# EasyEDA Pro project 一堆模块~.eprj (continued)
## Notes on the sheet (continued)
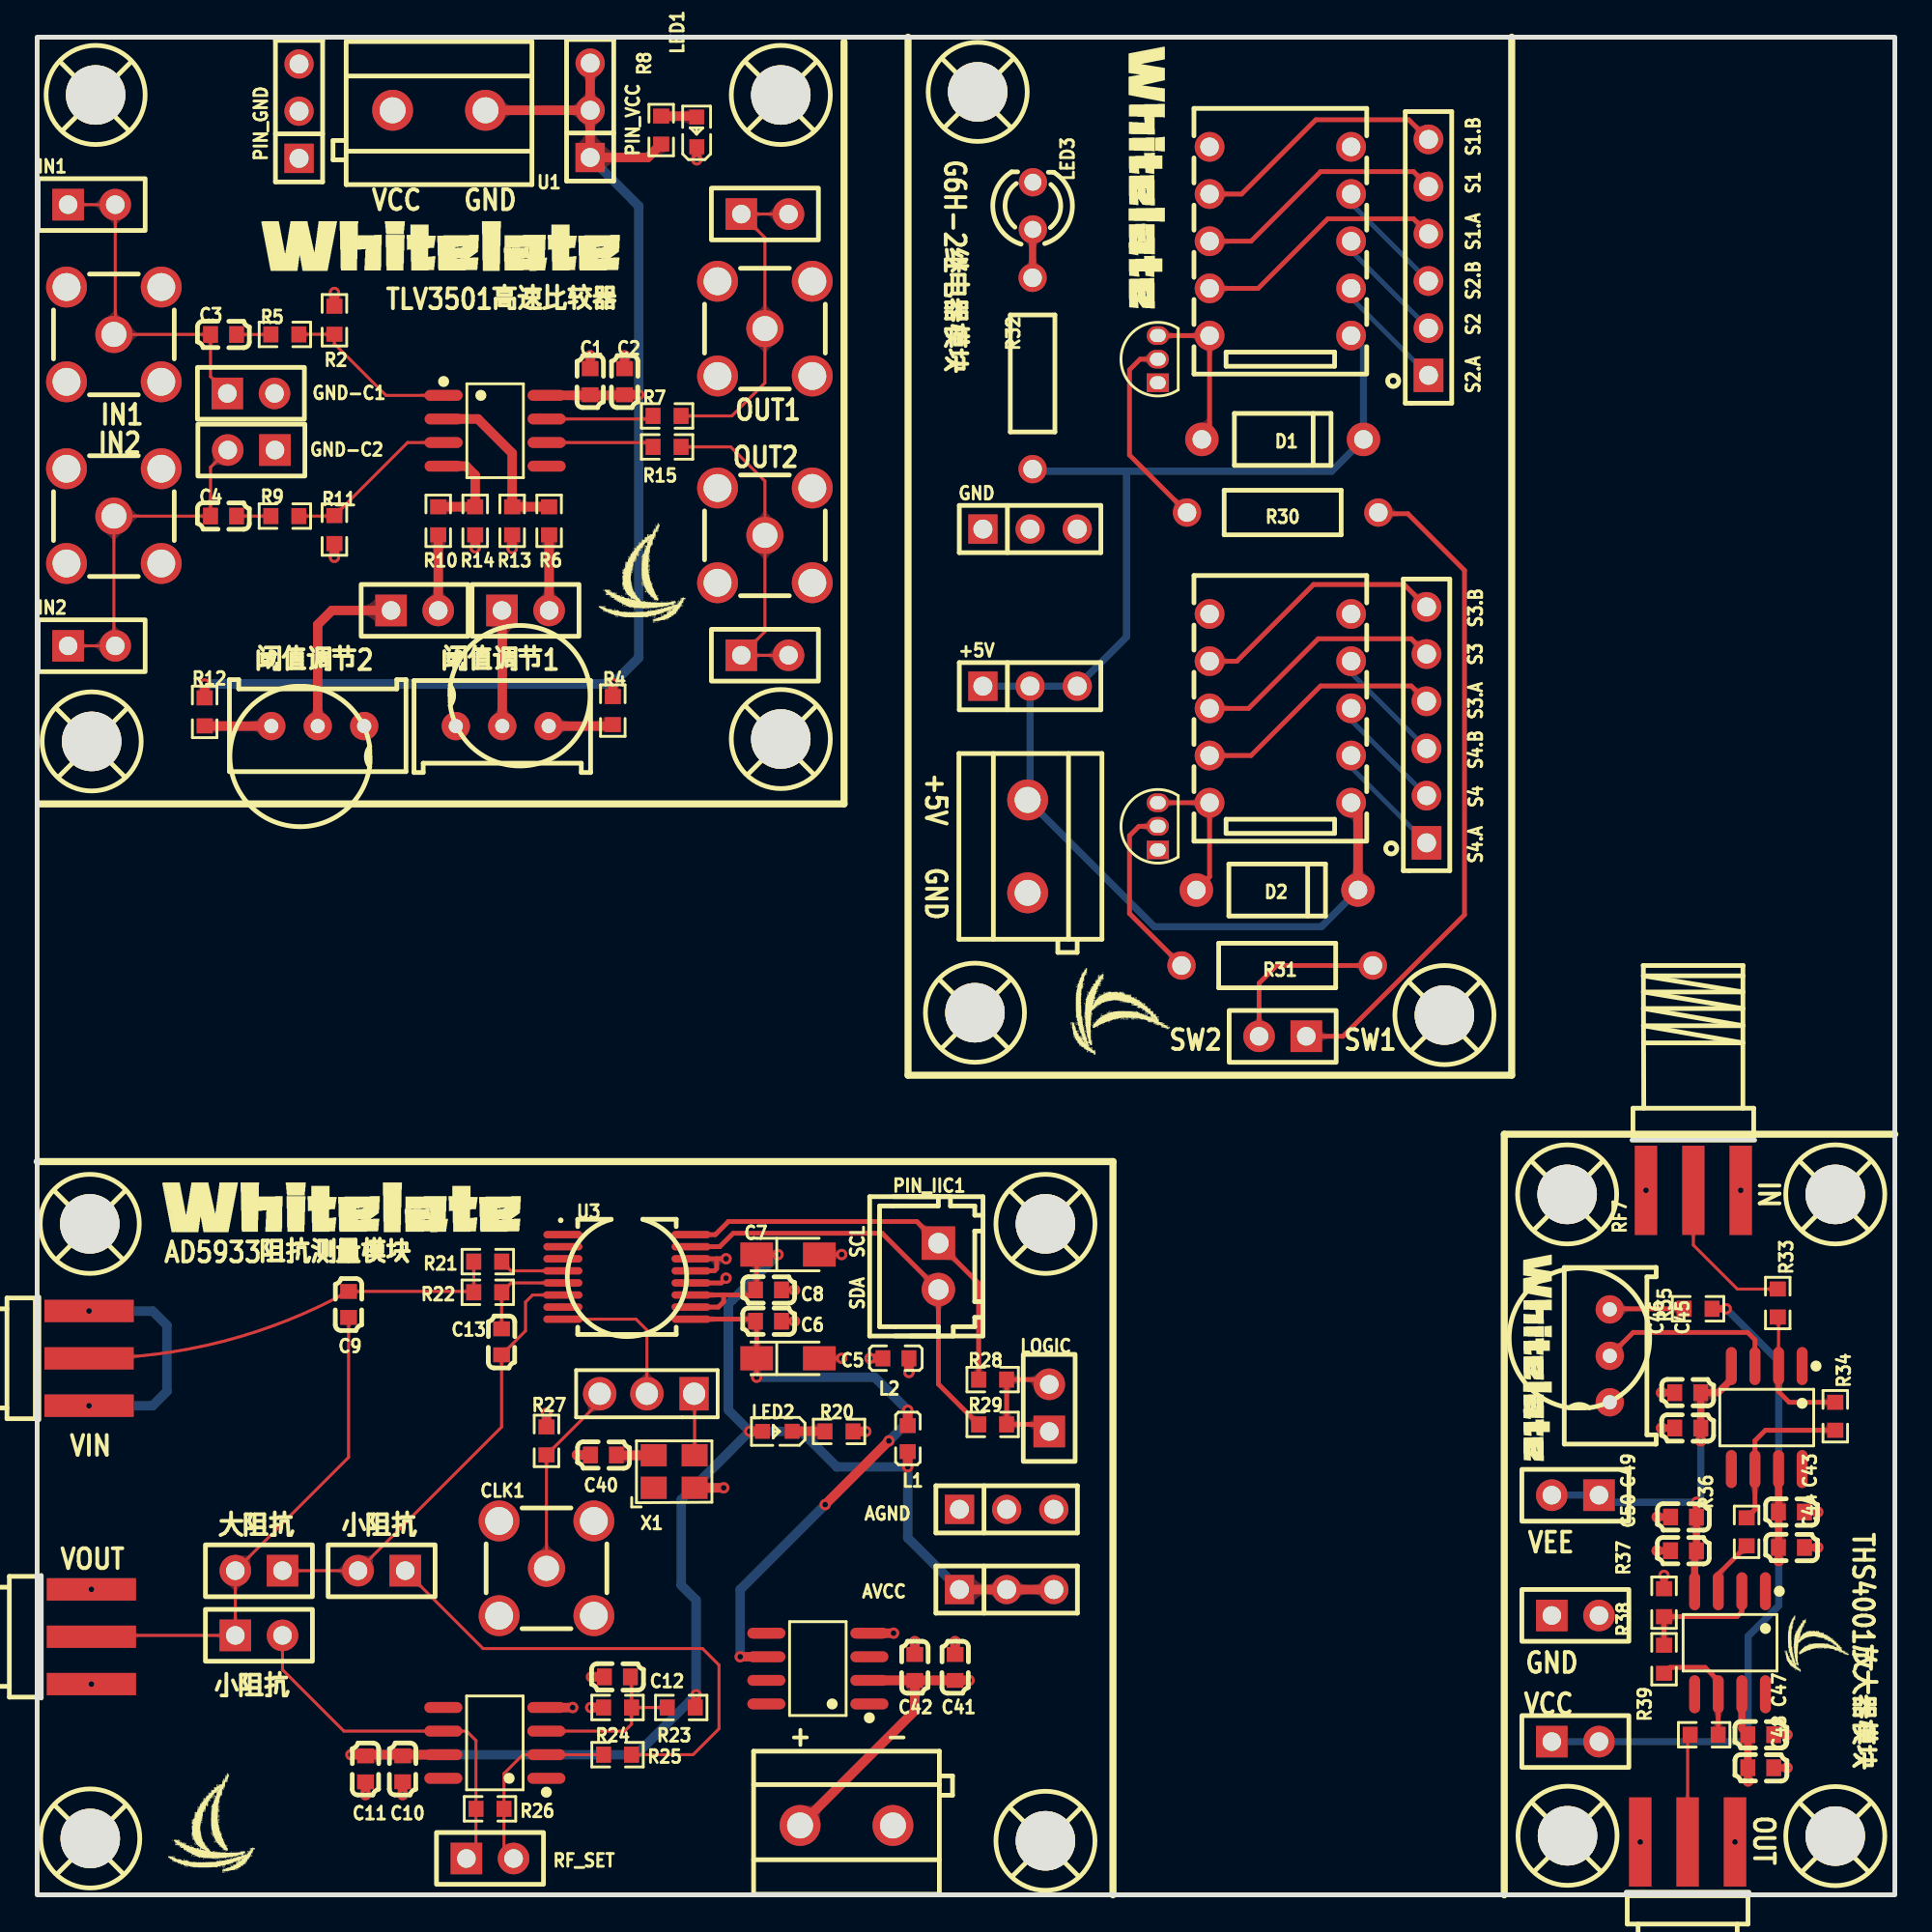
[diagram p1: board, top side]
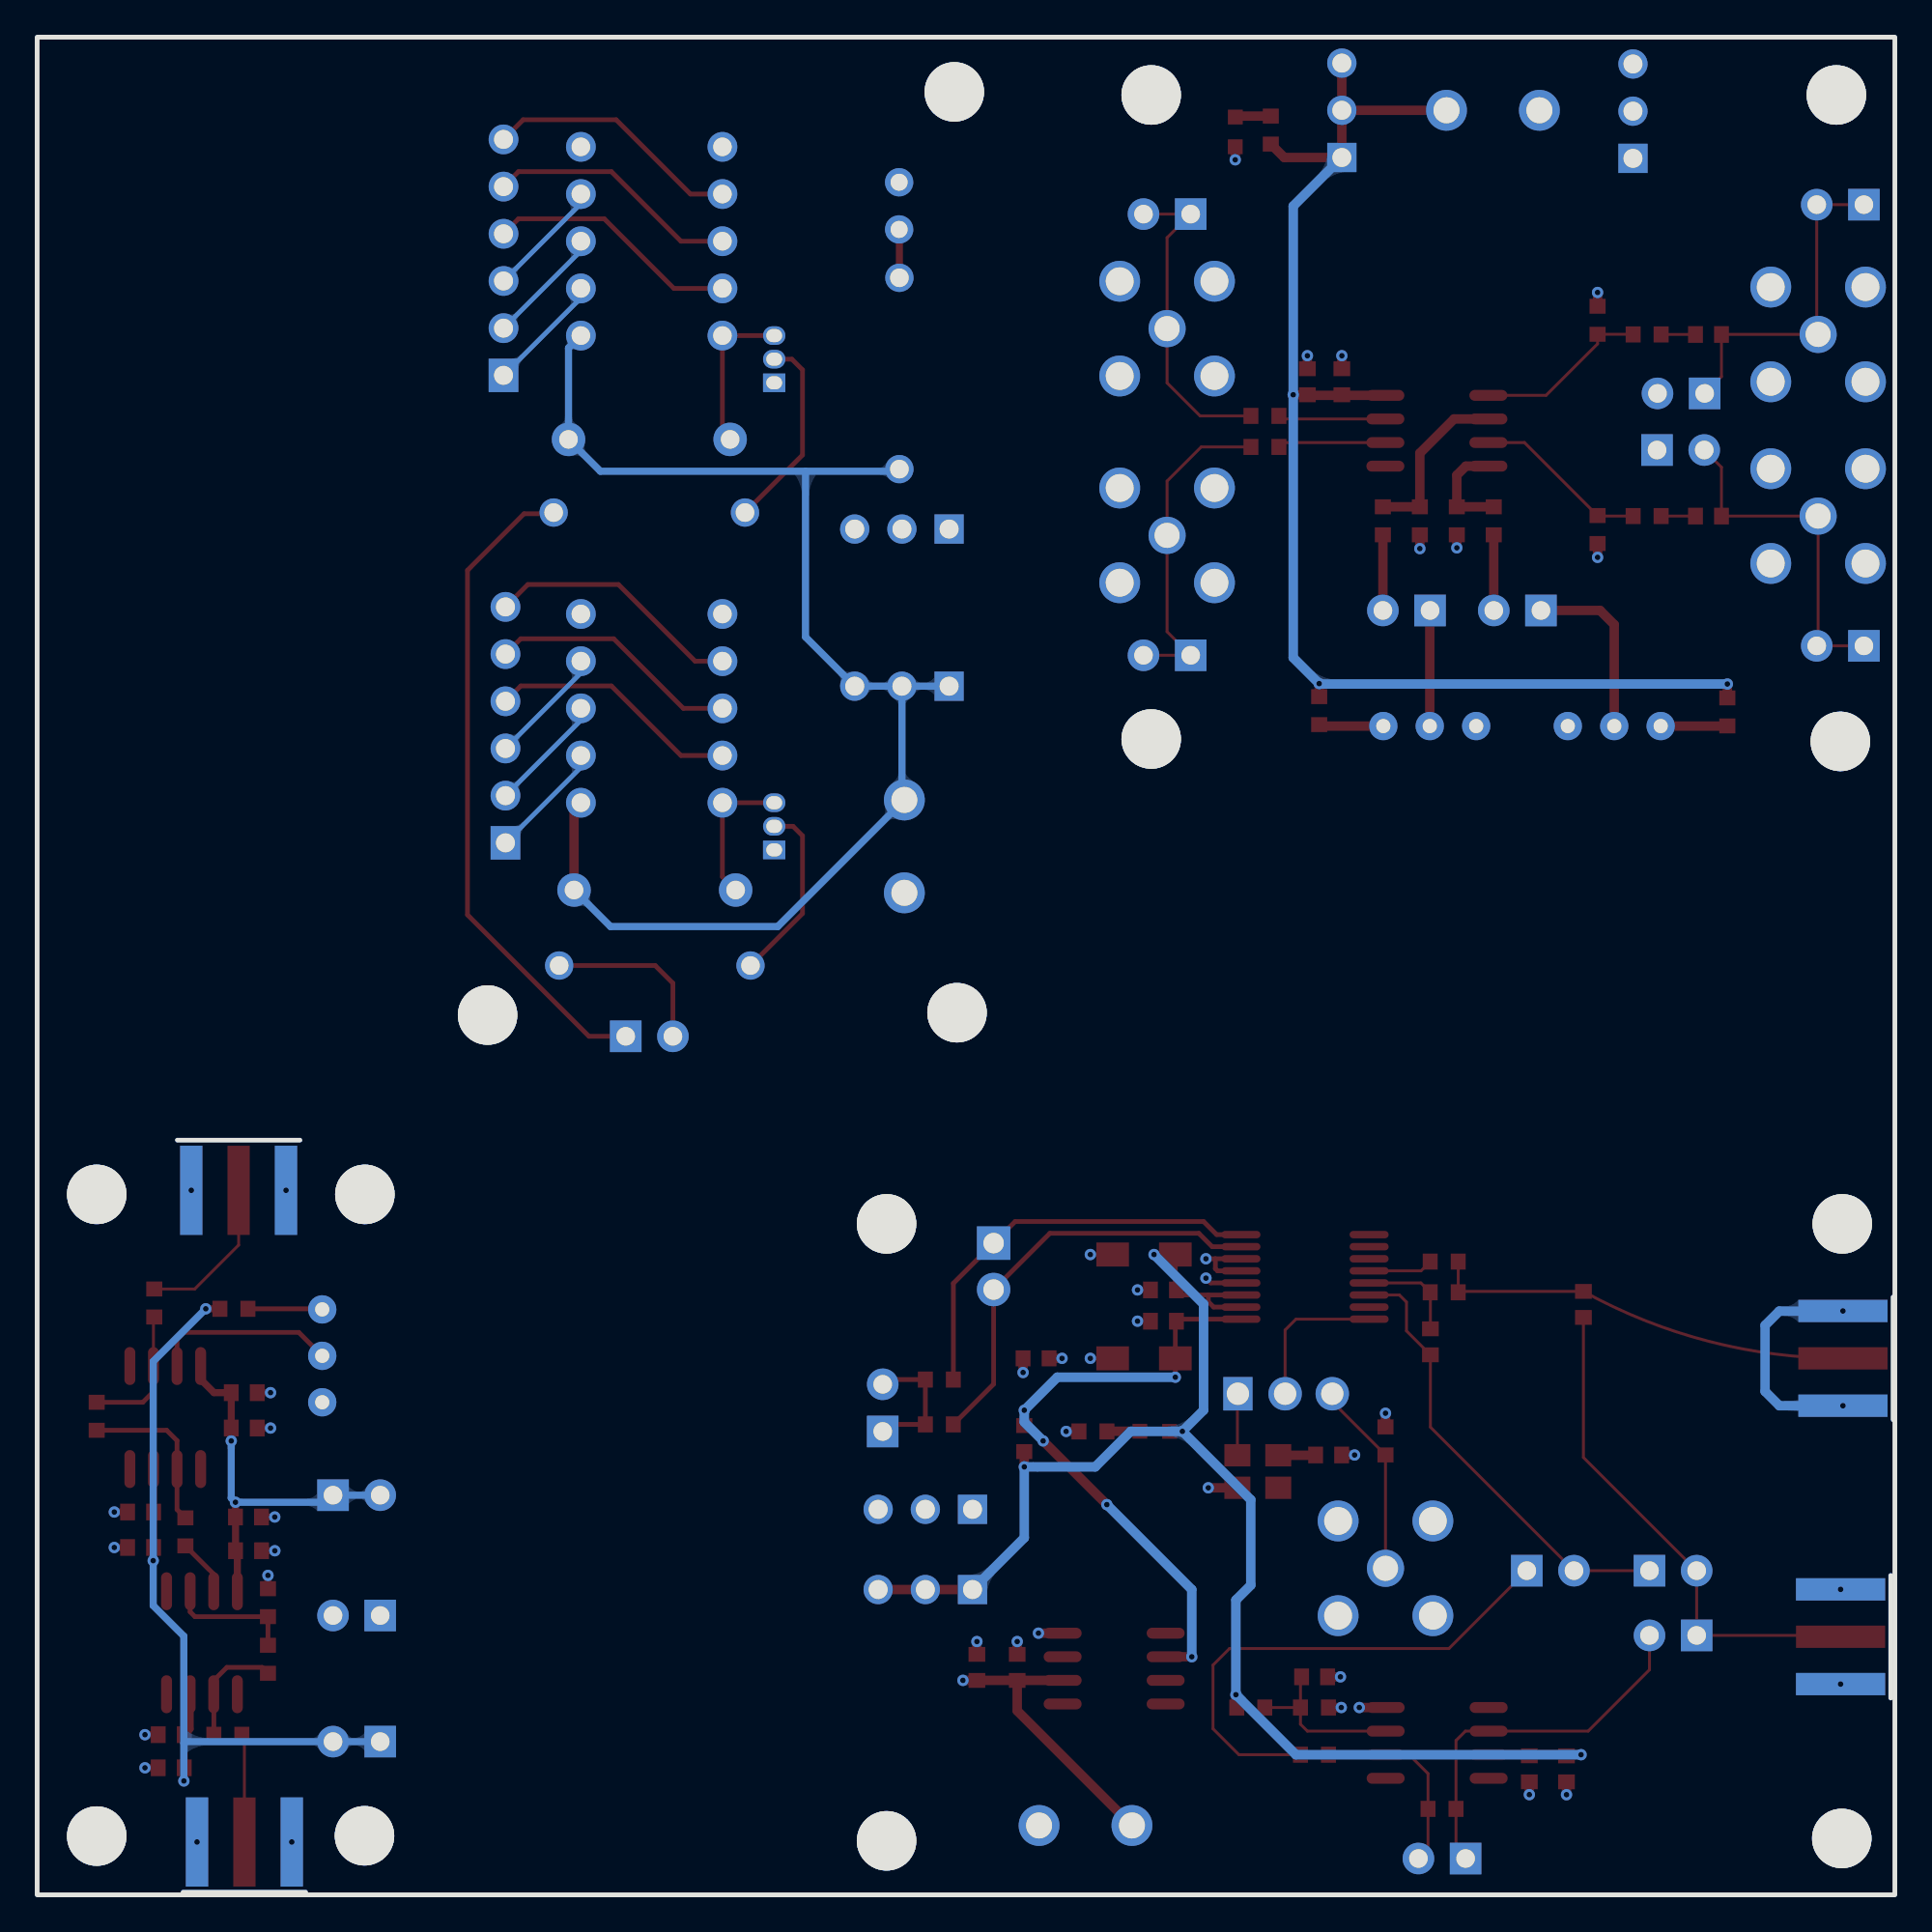
[diagram p2: board, bottom side, seen from below]

Outline 100 x 100 mm; copper layers: Top Layer, Bottom Layer. Coordinates in mm from the lower left corner of the outline.
Outline path: rectangle 0,100 100,0
Stack: Top Layer 0.035mm / Dielectric1 1.51mm FR4 er 4.5 / Bottom Layer 0.035mm

## Design rules (mm)
template: JLCPCB Capability(Two Layers Board)
spacing copperThickness1oz (default): track to track 0.102, other pairs 0.152 to 0.3
spacing copperThickness2oz: track to track 0.203, other pairs 0.152 to 0.3
track width copperThickness1oz (default): min 0.127, default 0.254, max 2.54
track width copperThickness2oz: min 0.203, default 0.254, max 2.54
differential pair differentialPair (default): width min 0.127, default 0.254, max 2.54; gap min 0.152, default 0.152
via viaSize (default): diameter min 0.5, default 0.61, max 10; hole min 0.3, default 0.305, max 6.3

## Placement (name value [footprint] x y rotation side)
+5V  -  [HDR-TH_3P-P2.54-V-F]  53.45 65.06 0 top
AGND  -  [HDR-TH_3P-P2.54-V-F]  52.19 20.75 0 top
AVCC  -  [HDR-TH_3P-P2.54-V-F]  52.19 16.43 0 top
C1  100nF  [C0603]  29.77 81.45 270 top
C2  10uF  [C0603]  31.62 81.45 270 top
C3  10uF  [C0603]  10.03 84 0 top
C4  10uF  [C0603]  10.03 74.22 0 top
C5  10uF  [CAP-SMD_L3.2-W1.6-RD-C7171]  40.42 28.88 0 top
C6  100nF  [C0603]  39.37 30.88 180 top
C7  10uF  [CAP-SMD_L3.2-W1.6-RD-C7171]  40.42 34.47 0 top
C8  100nF  [C0603]  39.37 32.56 180 top
C9  15pF  [C0603]  16.76 31.78 90 top
C10  100nF  [C0603]  19.68 6.78 90 top
C11  10uF  [C0603]  17.67 6.78 90 top
C12  1uF  [C0603]  31.23 11.74 180 top
C13  100nF  [C0603]  25 29.77 90 top
C40  0.1uF  [C0603]  30.48 23.68 180 top
C41  10uF  [C0603]  49.41 12.24 270 top
C42  0.1uF  [C0603]  47.24 12.24 270 top
C43  100nF  [C0603]  94.43 20.61 180 top
C44  10uF  [C0603]  94.43 18.7 180 top
C45  100nF  [C0603]  88.85 27.03 0 top
C46  10uF  [C0603]  88.85 25.13 0 top
C47  100nF  [C0603]  92.78 8.62 180 top
C48  10uF  [C0603]  92.78 6.84 180 top
C49  100nF  [C0603]  88.62 20.34 0 top
C50  10uF  [C0603]  88.62 18.52 0 top
CLK1  BWSMA-KE-Z001  [SMA-TH_BWSMA-KE-Z001]  27.42 17.58 0 top
D1  -  [DO_1N4007]  67.05 78.35 180 top
D2  -  [DO_1N4007]  66.75 54.09 180 top
GND  -  [HDR-TH_3P-P2.54-V-F]  53.45 73.52 0 top
GND-C1  -  [HDR-TH_2P-P2.54-V-F]  11.51 80.82 0 top
GND-C2  -  [HDR-TH_2P-P2.54-V-F]  11.53 77.78 180 top
H1  -  [HDR-TH_2P-P2.54-V-F]  26.29 69.14 0 top
H2  -  [HDR-TH_2P-P2.54-V-F]  20.32 69.14 0 top
H4  -  [HDR-TH_2P-P2.54-V-F]  11.94 13.97 0 top
H6  2.54-1*3P针  [HDR-TH_3P-P2.54-V-M-1]  32.82 26.97 180 top
H7  -  [HDR-TH_2P-P2.54-V-F]  11.94 17.45 180 top
H8  -  [HDR-TH_2P-P2.54-V-F]  18.54 17.45 180 top
H9  -  [HDR-TH_6P-P2.54-V-F]  74.9 88.14 90 top
H10  -  [HDR-TH_6P-P2.54-V-F]  74.79 62.98 90 top
H11  -  [HDR-TH_2P-P2.54-V-F]  67.05 46.22 180 top
H12  -  [HDR-TH_2P-P2.54-V-F]  82.8 8.25 0 top
H13  -  [HDR-TH_2P-P2.54-V-F]  82.8 21.51 180 top
H14  -  [HDR-TH_2P-P2.54-V-F]  82.8 15.04 0 top
IN1  -  [HDR-TH_2P-P2.54-V-F]  2.94 90.98 0 top
IN2  -  [HDR-TH_2P-P2.54-V-F]  2.94 67.23 0 top
L1  10uH  [L0603]  46.86 24.56 270 top
L2  10uH  [L0603]  46.23 28.88 0 top
LED1  -  [LED_0603]  35.5 94.95 90 top
LED2  -  [LED_0603]  39.79 24.95 180 top
LED3  -  [LED_TH-3mm]  53.6 90.92 90 top
LOGIC  -  [HDR-TH_2P-P2.54-V-F]  54.48 26.21 90 top
OUT  -  [HDR-TH_2P-P2.54-V-F]  39.18 90.47 0 top
OUT1  -  [HDR-TH_2P-P2.54-V-F]  39.18 66.73 0 top
PIN_GND  -  [HDR-TH_3P-P2.54-V-F]  14.1 96.02 90 top
PIN_IIC1  ZX-XH2.54-2PZZ  [CONN-TH_2P-P2.50_HX25003-2A]  48.51 33.83 270 top
PIN_VCC  -  [HDR-TH_3P-P2.54-V-F]  29.77 96.06 90 top
PR1  10kΩ  [R_3296]  25.04 63.04 0 top
PR2  10kΩ  [R_3296]  15.1 62.79 180 top
PR3  10kΩ  [R_3296]  84.53 29.02 90 top
Q1  S8050  [TO-92-3_L4.5-W3.5-P1.27-L]  60.32 82.67 90 top
Q2  S8050  [TO-92-3_L4.5-W3.5-P1.27-L]  60.32 57.52 90 top
R2  30K  [R0603]  16 84.76 90 top
R4  1K  [R0603]  30.99 63.75 270 top
R5  0R  [R0603]  13.33 84 0 top
R6  0R  [R0603]  27.56 73.97 90 top
R7  0R  [R0603]  33.91 79.61 0 top
R8  1K  [R0603]  33.59 95 270 top
R9  0R  [R0603]  13.33 74.22 0 top
R10  0R  [R0603]  21.59 73.97 90 top
R11  30K  [R0603]  16 73.49 270 top
R12  1K  [R0603]  9.02 63.68 270 top
R13  30K  [R0603]  25.57 73.97 270 top
R14  30K  [R0603]  23.58 73.97 270 top
R15  0R  [R0603]  33.91 77.94 0 top
R20  1K  [R0603]  43.17 24.95 180 top
R21  200K  [R0603]  24.26 34.09 0 top
R22  0R  [R0603]  24.26 32.44 0 top
R23  20K  [R0603]  34.67 10.08 180 top
R24  20K  [R0603]  31.24 10.08 180 top
R25  4K  [R0603]  31.24 7.54 0 top
R26  20K  [R0603]  24.38 4.63 0 top
R27  50R  [R0603]  27.42 24.44 270 top
R28  2k2  [R0603]  51.44 27.74 0 top
R29  2k2  [R0603]  51.44 25.32 0 top
R30  1K  [Res_1/4W]  67.05 74.41 180 top
R31  1K  [Res_1/4W]  66.75 50.03 180 top
R32  1K  [Res_1/4W]  53.59 81.9 270 top
R33  10K  [R0603]  93.7 31.86 270 top
R34  10K  [R0603]  96.79 25.76 270 top
R35  10K  [R0603]  89.41 31.55 180 top
R36  0R  [R0603]  92.02 19.54 270 top
R37  NC  [R0603]  87.58 15.73 270 top
R38  0R  [R0603]  87.58 12.68 270 top
R39  0R  [R0603]  89.73 8.62 180 top
RF1  BWSMA-KE-Z001  [SMA-TH_BWSMA-KE-Z001]  4.13 84 0 top
RF2  BWSMA-KE-Z001  [SMA-TH_BWSMA-KE-Z001]  4.13 74.22 0 top
RF3  BWSMA-KE-Z001  [SMA-TH_BWSMA-KE-Z001]  39.18 84.31 0 top
RF4  BWSMA-KE-Z001  [SMA-TH_BWSMA-KE-Z001]  39.18 73.18 0 top
RF5  BWSMA-KE-P001  [SMA-SMD_BWSMA-KE-P001]  2.79 28.88 180 top
RF6  BWSMA-KE-P001  [SMA-SMD_BWSMA-KE-P001]  2.92 13.89 180 top
RF7  BWSMA-KE-P001  [SMA-SMD_BWSMA-KE-P001]  89.15 37.93 90 top
RF8  BWSMA-KE-P001  [SMA-SMD_BWSMA-KE-P001]  88.84 2.84 270 top
RF_SET  -  [HDR-TH_2P-P2.54-V-F]  24.38 1.96 0 top
TP1  -  [M3螺丝]  40.09 96.83 0 top
TP2  -  [M3螺丝]  40.09 62.15 0 top
TP3  -  [M3螺丝]  3 62.03 0 top
TP4  -  [M3螺丝]  3.21 96.83 0 top
TP5  -  [M3螺丝]  2.92 2.97 0 top
TP6  -  [M3螺丝]  54.34 2.84 0 top
TP7  -  [M3螺丝]  54.34 36.06 0 top
TP8  -  [M3螺丝]  2.89 36.06 0 top
TP9  -  [M3螺丝]  50.55 47.42 0 top
TP10  -  [M3螺丝]  50.69 96.99 0 top
TP12  -  [M3螺丝]  75.82 47.3 0 top
TP13  -  [M3螺丝]  82.42 37.64 0 top
TP14  -  [M3螺丝]  82.44 3.12 0 top
TP15  -  [M3螺丝]  96.86 37.64 0 top
TP16  -  [M3螺丝]  96.86 3.1 0 top
U1  KF301-5.0-2P  [CONN-TH_P5.00_KF301-5.0-2P]  21.63 96.06 180 top
U2  TLV3502AIDR  [SOIC-8_L4.9-W3.9-P1.27-LS6.0-BL]  24.65 78.81 270 top
U3  AD5933YRSZ  [SSOP-16_L6.2-W5.3-P0.65-LS7.8-BL]  31.75 33.27 270 top
U4  THS4001CDR  [SOIC-8_L4.9-W3.9-P1.27-LS6.0-BL]  24.64 8.18 90 top
U5  ADR435BR  [SOIC-8_L4.9-W3.9-P1.27-LS6.0-BL]  42.03 12.18 90 top
U6  KF301-5.0-2P  [CONN-TH_P5.00_KF301-5.0-2P]  43.57 3.73 0 top
U7  G6H-2-DC5  [RELAY-TH_G6H-2]  66.92 89.02 90 top
U8  G6H-2-DC5  [RELAY-TH_G6H-2]  66.92 63.87 90 top
U10  KF301-5.0-2P  [CONN-TH_P5.00_KF301-5.0-2P]  53.32 56.44 270 top
U11  THS4001CDR  [SOIC-8_L4.9-W3.9-P1.27-LS6.0-BL]  93.1 25.69 180 top
U12  THS4001CDR  [SOIC-8_L4.9-W3.9-P1.27-LS6.0-BL]  91.13 13.57 180 top
X1  16MHz  [OSC-SMD_4P-L3.2-W2.5-BL]  34.29 22.79 0 top

## Footprints (pads in the part's own frame, mm; a bottom-side part is the same pattern mirrored in y, then rotated)
C0603
  rect 0.8x0.9 smd: 1(-0.7,0) 2(0.7,0)
CAP-SMD_L3.2-W1.6-RD-C7171
  rect 1.758x1.296 smd: 1(-1.687,0) 2(1.687,0)
CONN-TH_2P-P2.50_HX25003-2A
  rect 1.8x1.8 hole 1.1: 1(-1.25,0)
  round 1.8 hole 1.1: 2(1.25,0)
CONN-TH_P5.00_KF301-5.0-2P
  round 2.2 hole 1.4: 1(-2.5,0) 2(2.5,0)
DO_1N4007
  round 1.8 hole 1: 1(-4.35,0) 2(4.35,0)
HDR-TH_2P-P2.54-V-F
  rect 1.7x1.7 hole 1: 1(-1.27,0)
  round 1.7 hole 1: 2(1.27,0)
HDR-TH_3P-P2.54-V-F
  rect 1.575x1.575 hole 1.02: 1(-2.54,0)
  round 1.575 hole 1.02: 2(0,0) 3(2.54,0)
HDR-TH_3P-P2.54-V-M-1
  rect 1.575x1.8 hole 1.2: 1(-2.54,0)
  round 1.8 hole 1.2: 2(0,0) 3(2.54,0)
HDR-TH_6P-P2.54-V-F
  rect 1.8x1.6 hole 1.02: 1(-6.35,0)
  round 1.6 hole 1.02: 2(-3.81,0) 3(-1.27,0) 4(1.27,0) 5(3.81,0) 6(6.35,0)
L0603
  rect 0.8x0.864 smd: 1(-0.7,0) 2(0.7,0)
LED_0603
  rect 0.8x0.8 smd: 1(-0.851,-0.01) 2(0.75,-0.005)
LED_TH-3mm
  round 1.524 hole 0.914: 1(-1.27,0) 2(1.27,0)
M3螺丝
  round 3.2 hole 3.2: 1(-0.064,0.064)
OSC-SMD_4P-L3.2-W2.5-BL
  rect 1.4x1.2 smd: 1(-1.1,-0.875) 2(1.1,-0.875) 3(1.1,0.875) 4(-1.1,0.875)
R0603
  rect 0.806x0.864 smd: 1(-0.753,0) 2(0.753,0)
R_3296
  round 1.524 hole 0.762: 1(-2.499,-0.127) 2(0,-0.127) 3(2.499,-0.127)
RELAY-TH_G6H-2
  round 1.6 hole 1: 1(-5.08,-3.81) 2(-2.54,-3.81) 3(0,-3.81) 4(2.54,-3.81) 5(5.08,-3.81) 6(5.08,3.81) 7(2.54,3.81) 8(0,3.81) 9(-2.54,3.81) 10(-5.08,3.81)
Res_1/4W
  round 1.524 hole 1: 1(-5.15,0) 2(5.15,0)
SMA-SMD_BWSMA-KE-P001
  rect 4.8x1.2 smd: 1(0,-2.55) 2(0,2.55) 5(0,0)
  rect 4.8x1.2 smd far side: 3(0,2.55) 4(0,-2.55)
SMA-TH_BWSMA-KE-Z001
  round 2.2 hole 1.5: 1(-2.55,-2.55) 2(-2.55,2.55) 3(2.55,2.55) 4(2.55,-2.55)
  round 2 hole 1.35: 5(0,0)
SOIC-8_L4.9-W3.9-P1.27-LS6.0-BL
  oval 0.588x2.045 smd: 1(-1.905,-2.772) 2(-0.635,-2.772) 3(0.635,-2.772) 4(1.905,-2.772) 5(1.905,2.772) 6(0.635,2.772) 7(-0.635,2.772) 8(-1.905,2.772)
SSOP-16_L6.2-W5.3-P0.65-LS7.8-BL
  oval 0.4x2.1 smd: 1(-2.275,-3.45) 2(-1.625,-3.45) 3(-0.975,-3.45) 4(-0.325,-3.45) 5(0.325,-3.45) 6(0.975,-3.45) 7(1.625,-3.45) 8(2.275,-3.45) 9(2.275,3.45) 10(1.625,3.45) 11(0.975,3.45) 12(0.325,3.45) 13(-0.325,3.45) 14(-0.975,3.45) 15(-1.625,3.45) 16(-2.275,3.45)
TO-92-3_L4.5-W3.5-P1.27-L
  rect 1x1.2 hole 0.7x0.85: 1(-1.27,0)
  oval 1x1.2 hole 0.7x0.85: 2(0,0) 3(1.27,0)

## Nets
As in the schematic, except:
AGND: AGND.1 AGND.2 AGND.3 C7.2 C8.1 C10.1 C11.1 C12.2 C41.1 C42.1 L2.2 R20.1 R24.2 RF5.1 RF5.2 RF5.3 RF5.4 RF6.1 RF6.2 RF6.3 RF6.4 TP5.1 TP6.1 TP7.1 TP8.1 U3.13 U3.14 U4.4 U5.4 U6.2
AVCC: AVCC.1 AVCC.2 AVCC.3 C7.1 C8.2 C10.2 C11.2 L1.2 LED2.2 R23.1 U3.10 U3.11 U4.7
$1N17115: H4.2 R26.1 RF_SET.1 U4.6
$1N17132: R25.1 R26.2 RF_SET.2 U4.2

Pads without a net: U3 1 2 3 7; U4 1 5 8; U5 1 3 5 7 8; U7 5 6; U8 5 6; U11 1 5 8; U12 1 5 8; X1 1

## Via types
v1: diameter 0.61, hole 0.305, Top Layer to Bottom Layer, 63 vias

## Routing (per net, layer and track width the routed paths; a pad name or vN(x,y) marks a point on that pad's centre or on a via; arc(x,y) is an arc through that point)
+5V: length 74.6
  Top Layer w0.508: U8.1 71.1,58.42 D2.1
  Bottom Layer w0.381: +5V.2 53.45,59.07 U10.1 60.14,52.12 69.13,52.12 D2.1 ; +5V.2 +5V.1 ; +5V.2 +5V.3 58.64,67.71 58.64,76.63 ; 58.64,76.63 69.68,76.63 D1.1 71.4,83.27 U7.1 ; 58.64,76.63 53.7,76.63 R32.2
AGND: length 26.6
  Top Layer w0.254: 36.58,34.24 36.58,33.71 36.46,33.59 U3.13 ; 36.58,34.24 U3.14 ; 36.58,34.24 v1(37.08,34.24) ; C7.2 v1(43.31,34.47) ; C8.1 v1(40.77,32.56)
  Top Layer w0.508: C12.2 v1(29.84,11.74) ; R20.1 v1(44.61,24.95) ; 49.41,12.94 v1(49.41,13.63) ; C11.1 v1(17.67,5.39) ; C10.1 v1(19.68,5.39) 19.69,5.38 ; R24.2 v1(29.8,10.08) ; U5.4 v1(46.1,14.09) ; 47.24,12.94 v1(47.24,13.63) ; U4.4 v1(28.83,10.08) ; L2.2 v1(46.93,28.12)
  Bottom Layer w0.508: v1(2.79,26.33) 6.21,26.33 6.98,27.1 6.98,30.66 6.22,31.42 2.8,31.42 v1(2.79,31.43)
  vias: v1(2.92,16.44) v1(2.92,11.34)
AVCC: length 85.3
  Top Layer w0.254: 36.97,32.29 36.96,32.28 36.96,31.93 36.67,31.64 U3.10 ; 36.97,32.29 38.4,32.29 C8.2 38.73,32.62 C7.1 v1(39.88,34.47) ; 36.97,32.29 U3.11
  Top Layer w0.508: 39.04,24.95 v1(38.35,24.95) ; L1.2 v1(46.86,23.04) ; v1(16.89,7.54) 17.61,7.54 C11.2 17.74,7.54 U4.7 ; AVCC.3 AVCC.2 AVCC.1 ; 35.47,10.08 v1(35.47,10.77)
  Bottom Layer w0.508: v1(38.35,24.95) 37.21,26.09 37.21,31.8 v1(39.88,34.47) ; v1(38.35,24.95) 34.67,21.27 34.67,16.67 35.47,15.87 v1(35.47,10.77) 32.24,7.54 v1(16.89,7.54) ; v1(38.35,24.95) 41.13,24.95 43.04,23.04 v1(46.86,23.04) 46.86,19.22 AVCC.1
DVCC: length 34.7
  Top Layer w0.254: v1(38.73,27.86) C5.1 38.73,30.82 C6.2 38.56,30.99 U3.9
  Top Layer w0.508: L1.1 v1(46.86,26.09) ; v1(45.85,24.44) v1(42.42,21.01) ; 39.25,12.82 v1(37.85,12.82)
  Bottom Layer w0.508: v1(37.85,12.82) 37.85,16.43 v1(42.42,21.01) ; v1(38.73,27.86) 45.09,27.86 v1(46.86,26.09) 46.86,25.45 v1(45.85,24.44)
DVDD: length 2
  Top Layer w0.508: X1.4 31.2,23.66 C40.1
GND: length 11.3
  Top Layer w0.381: C44.1 v1(95.85,18.7) ; C50.1 v1(87.21,18.52) ; R37.1 v1(87.58,17.2) ; C46.1 v1(87.44,25.13) ; C47.1 v1(94.2,8.62) ; C49.1 v1(87.21,20.34) ; C45.1 v1(87.44,27.03) ; C48.1 v1(94.2,6.84) ; C43.1 v1(95.85,20.61)
  Top Layer w0.508: v1(23.58,72.51) R14.2 ; v1(29.77,82.85) C1.1 ; v1(16,72) 16,72.7 ; v1(31.62,82.85) C2.1 ; v1(35.51,93.4) LED1.1 ; v1(25.57,72.47) 25.57,73.17 ; v1(16,86.26) 16,85.56
  vias: v1(86.29,2.84) v1(86.6,37.93) v1(91.39,2.84) v1(91.7,37.93)
PGND: length 7.5
  Top Layer w0.254: C6.1 v1(40.77,30.88) ; U3.12 36.83,32.94 v1(37.08,33.2) ; C5.2 v1(43.31,28.88)
  Top Layer w0.508: C40.2 v1(29.08,23.68) ; L2.1 v1(44.83,28.88) ; X1.2 v1(36.96,21.91) ; 27.42,25.24 v1(27.42,25.93)
VCC: length 121.4
  Top Layer w0.381: 90.21,31.55 v1(90.92,31.55) ; U12.7 91.76,8.94 C47.2 C48.2 92.08,6.15 ; 93.73,18.09 C44.2 93.74,18.71 U11.7
  Top Layer w0.508: U2.8 31.59,80.72 C2.2 v1(32.38,80.75) ; U1.1 PIN_VCC.2 ; PIN_VCC.2 PIN_VCC.3 ; PIN_VCC.2 PIN_VCC.1 32.87,93.52 R8.2 ; v1(9.02,65.18) 9.02,64.48 ; v1(30.99,65.2) 30.99,64.5
  Bottom Layer w0.381: v1(90.92,31.55) 93.75,28.72 v1(93.75,17.99) 93.75,15.57 92.1,13.92 92.1,8.17 ; H12.1 H12.2 92.02,8.25 92.1,8.17 ; 92.1,8.17 v1(92.1,6.13)
  Bottom Layer w0.508: PIN_VCC.1 32.38,90.91 v1(32.38,80.75) 32.38,66.6 v1(30.99,65.2) 30.97,65.18 v1(9.02,65.18)
VEE: length 21.4
  Top Layer w0.381: v1(89.32,21.13) C49.2 89.32,20.34 C50.2 89.22,18.43 U12.4 ; U11.4 91.2,27.75 90.48,27.03 C45.2 C46.2 v1(89.55,24.44)
  Bottom Layer w0.381: v1(89.55,24.44) 89.55,21.36 v1(89.32,21.13) 84.45,21.13 H13.1 H13.2
DC_IN: length 15.7
  Top Layer w0.508: U6.1 47.24,9.91 C42.2 ; v1(50.16,11.55) U5.2
LOGIC: length 7.3
  Top Layer w0.254: 54.48,24.94 54.1,25.32 R29.2 R28.2 54.23,27.74 LOGIC.2
REF1: length 4.1
  Top Layer w0.508: H1.2 R6.1
REF2: length 4.1
  Top Layer w0.508: H2.2 R10.1
S1: length 13.7
  Top Layer w0.254: U7.8 65.34,89.02 69.09,92.76 74.09,92.76 H9.5
S1.A: length 13.7
  Top Layer w0.254: 74.9,89.42 74.09,90.22 69.47,90.22 65.72,86.47 U7.9
S1.B: length 13.9
  Top Layer w0.254: U7.7 64.83,91.56 68.83,95.56 73.84,95.56 74.9,94.5
S2: length 6.4
  Bottom Layer w0.254: U7.3 70.73,88.5 H9.2
S2.A: length 6.4
  Bottom Layer w0.254: U7.2 70.73,85.96 H9.1
S2.B: length 6.4
  Bottom Layer w0.254: H9.3 70.73,91.04 U7.4
S3: length 13.6
  Top Layer w0.254: H10.5 73.97,67.61 68.96,67.61 65.22,63.87 U8.8
S3.A: length 13.6
  Top Layer w0.254: H10.4 73.97,65.08 69.09,65.08 65.34,61.33 U8.9
S3.B: length 13.9
  Top Layer w0.254: H10.6 73.59,70.54 68.71,70.54 64.58,66.41 U8.7
S4: length 6.4
  Bottom Layer w0.254: U8.3 70.73,63.23 H10.2
S4.A: length 6.4
  Bottom Layer w0.254: U8.2 70.73,60.69 H10.1
S4.B: length 6.4
  Bottom Layer w0.254: H10.3 70.73,65.77 U8.4
SCL: length 22.3
  Top Layer w0.254: R28.1 50.68,32.92 PIN_IIC1.1 47.35,36.25 37.21,36.25 36.51,35.54 U3.16
SDA: length 23
  Top Layer w0.254: U3.15 36.74,34.89 37.47,35.61 45.49,35.61 PIN_IIC1.2 48.51,27.49 R29.1
SW1: length 35.7
  Top Layer w0.254: 72.2,74.41 72.26,74.35 73.79,74.35 76.84,71.3 76.84,52.76 70.29,46.22 H11.1
SW2: length 9.4
  Top Layer w0.254: R31.1 66.73,50.03 65.78,49.07 H11.2
$1N799: length 3.5
  Top Layer w0.508: PR1.3 30.91,62.92 R4.2
$1N1389: length 5.8
  Top Layer w0.158: U2.7 32.99,79.45 R7.1
$1N1441: length 17.4
  Top Layer w0.158: OUT.2 OUT.1 39.18,89.21 RF3.5 39.18,81.39 37.4,79.61 R7.2
$1N1870: length 1.9
  Top Layer w0.508: LED1.2 35.45,95.75 33.59,95.75
$1N2711: length 1.8
  Top Layer w0.158: R5.1 12.58,84 C3.2
$1N2723: length 9.5
  Top Layer w0.158: U2.1 18.77,80.72 16,83.49 R2.1 14.1,84.01 R5.2
$1N2769: length 9.4
  Top Layer w0.158: U2.3 19.94,78.18 16.01,74.25 R11.1 15.97,74.22 R9.2
$1N2791: length 6.2
  Top Layer w0.508: PR1.2 25.04,69.12 H1.1
$1N2928: length 3.6
  Top Layer w0.508: PR2.3 9.03,62.92 R12.2
$1N2932: length 9.7
  Top Layer w0.508: PR2.2 15.1,68.38 15.87,69.14 H2.1
$1N3021: length 5.6
  Top Layer w0.508: R10.2 R14.1 23.58,76.42 23.09,76.91 U2.4
$1N3030: length 9.3
  Top Layer w0.508: R6.2 R13.1 25.57,77.61 23.73,79.45 U2.2
$1N3129: length 1.8
  Top Layer w0.158: R9.1 C4.2
$1N3385: length 5.8
  Top Layer w0.158: R15.1 32.92,78.18 U2.6
$1N3388: length 17.7
  Top Layer w0.158: R15.2 37.34,77.94 39.18,76.1 RF4.5 39.18,68 OUT1.1 OUT1.2
$1N3561: length 18.3
  Top Layer w0.158: GND-C1.1 9.33,81.73 C3.1 9.33,84 RF1.5 4.2,84.07 IN1.2 IN1.1
$1N3582: length 18.7
  Top Layer w0.158: IN2.1 IN2.2 4.13,67.31 RF2.5 C4.1 9.33,76.85 10.26,77.78
$1N4588: length 8.2
  Top Layer w0.158: U3.8 32.24,30.99 32.82,30.4 H6.2
$1N4608: length 1.8
  Top Layer w0.508: LED2.1 42.4,24.96 R20.2
$1N4821: length 3.5
  Top Layer w0.158: R21.2 25.51,33.59 U3.4
$1N8057: length 23
  Top Layer w0.158: R21.1 R22.1 23.46,32.48 16.76,32.48 arc(10.01,29.8) RF5.5
$1N8729: length 9.2
  Top Layer w0.158: R23.2 R24.1 ; R24.1 32,9.19 31.62,8.81 U4.3 ; R24.1 32,11.67 C12.1
$1N8955: length 5.5
  Top Layer w0.158: C13.2 25,32.43 R22.2 25.51,32.94 U3.5
$1N11254: length 3.3
  Top Layer w0.158: H6.1 35.39,26.95 X1.3
$1N11257: length 10.6
  Top Layer w0.158: CLK1.5 R27.2 30.28,26.55 30.28,26.97
$1N12100: length 27.7
  Top Layer w0.158: H8.1 24,13.26 35.81,13.26 36.7,12.37 36.7,8.94 35.31,7.54 R25.2
$1N12125: length 27.4
  Top Layer w0.158: RF6.5 2.99,13.97 H4.1 H7.2 16.76,23.55 C9.1
$1N12149: length 24.4
  Top Layer w0.158: H7.1 H8.2 25,25.18 25,29.07 26.29,30.36 26.29,31.91 26.67,32.29 U3.6
$1N13153: length 10.7
  Top Layer w0.254: Q1.2 59.37,82.67 58.8,82.09 58.8,77.51 R30.2
$1N13341: length 9.9
  Top Layer w0.254: Q2.2 59.31,57.52 58.8,57.01 58.8,52.83 R31.2
$1N14258: length 7.8
  Top Layer w0.254: D2.2 63.11,54.8 U8.10 Q2.3
$1N14277: length 8.5
  Top Layer w0.254: D1.2 63.11,78.76 U7.10 Q1.3
$1N14424: length 2.6
  Top Layer w0.381: LED3.1 53.59,89.64 R32.1
$1N14988: length 7.3
  Top Layer w0.158: U11.2 93.74,31.06 R33.2
  Top Layer w0.254: R34.1 94.31,26.52 93.73,27.1 93.73,28.45 U11.2
$1N15115: length 9.9
  Top Layer w0.254: U11.3 92.47,29.88 92.07,30.28 85.92,30.28 PR3.2
$1N15150: length 4
  Top Layer w0.254: R35.2 84.69,31.55 84.65,31.51
$1N15380: length 8.5
  Top Layer w0.158: RF7.5 89.15,34.98 91.52,32.61 R33.1
$1N15473: length 8.9
  Top Layer w0.254: R34.2 93.03,25.01 92.47,24.45 U11.6 92.47,20.74 R36.1
$1N16065: length 3.1
  Top Layer w0.254: R36.2 90.49,17.26 U12.3
$1N16070: length 6.9
  Top Layer w0.254: R38.1 R37.2 91.5,14.97 91.76,15.23 U12.2
$1N16122: length 6.3
  Top Layer w0.254: R38.2 87.89,12.24 89.79,12.24 90.49,11.54 U12.6 90.49,10.79 R39.1
$1N16128: length 5.8
  Top Layer w0.158: RF8.5 88.84,8.48 R39.2
$1N17115: length 20.4
  Top Layer w0.158: H4.2 13.21,12.12 16.51,8.81 U4.6 23.11,8.81 23.62,8.31 R26.1 23.62,2.47 RF_SET.1
$1N17132: length 10.6
  Top Layer w0.158: R25.1 U4.2 26.14,7.54 25.13,6.53 25.13,2.47 RF_SET.2

## Copper pours and planes (outline as drawn; the poured copper is in the pictures)
AGND on Top Layer: 0,38.99 57.11,38.99 57.11,0 0,0
GND on Top Layer: 47.44,100.13 79.04,100.13 79.04,44.43 47.44,44.43
GND on Top Layer: 79.63,40.56 100,40.56 100,0 79.63,0
GND on Top Layer: 0,100 42.93,100 42.93,59.36 0,59.36
GND on Bottom Layer: 0,100 42.93,100 42.93,59.36 0,59.36
GND on Bottom Layer: 47.54,100.13 79.04,100.13 79.04,44.55 47.54,44.55
GND on Bottom Layer: 79.63,40.56 100,40.56 100,0 79.63,0
PGND on Bottom Layer: 0,38.89 57.11,38.89 57.11,0 0,0

Small or netless copper shapes (teardrops, artwork), in the pictures only: 317 on Top Layer, 51 on Bottom Layer

## Text on the board
Top Silkscreen Layer: S1.B | S1 | S1.A | S2.B | S2 | S2.A | S3 | S3.B | S3.A | S4.B | S4.A | S4 | SCL | SDA | VOUT | VIN | IN2 | IN1 | VCC | GND | OUT2 | OUT1 | + | - | SW2 | SW1 | VEE | +5V | OUT | IN | AD5933阻抗测量模块 | 小阻抗 | 大阻抗 | 阈值调节2 | TLV3501高速比较器 | 阈值调节1 | G6H-2继电器模块 | THS4001放大器模块
